# EasyEDA Pro project URADORRY-SUN.eprj, schematic Sub - ATmega32U4/Rev1.0
Create Date: 2024-05-28; Page Name: base; Project Name: URADORRY-SUN; Schematic Name: Sub - ATmega32U4/Rev1.0; Update Date: 2024-05-31; Add into BOM: yes; Company: 整数71の情報処理; Convert to PCB: yes; Drawed: 整数71
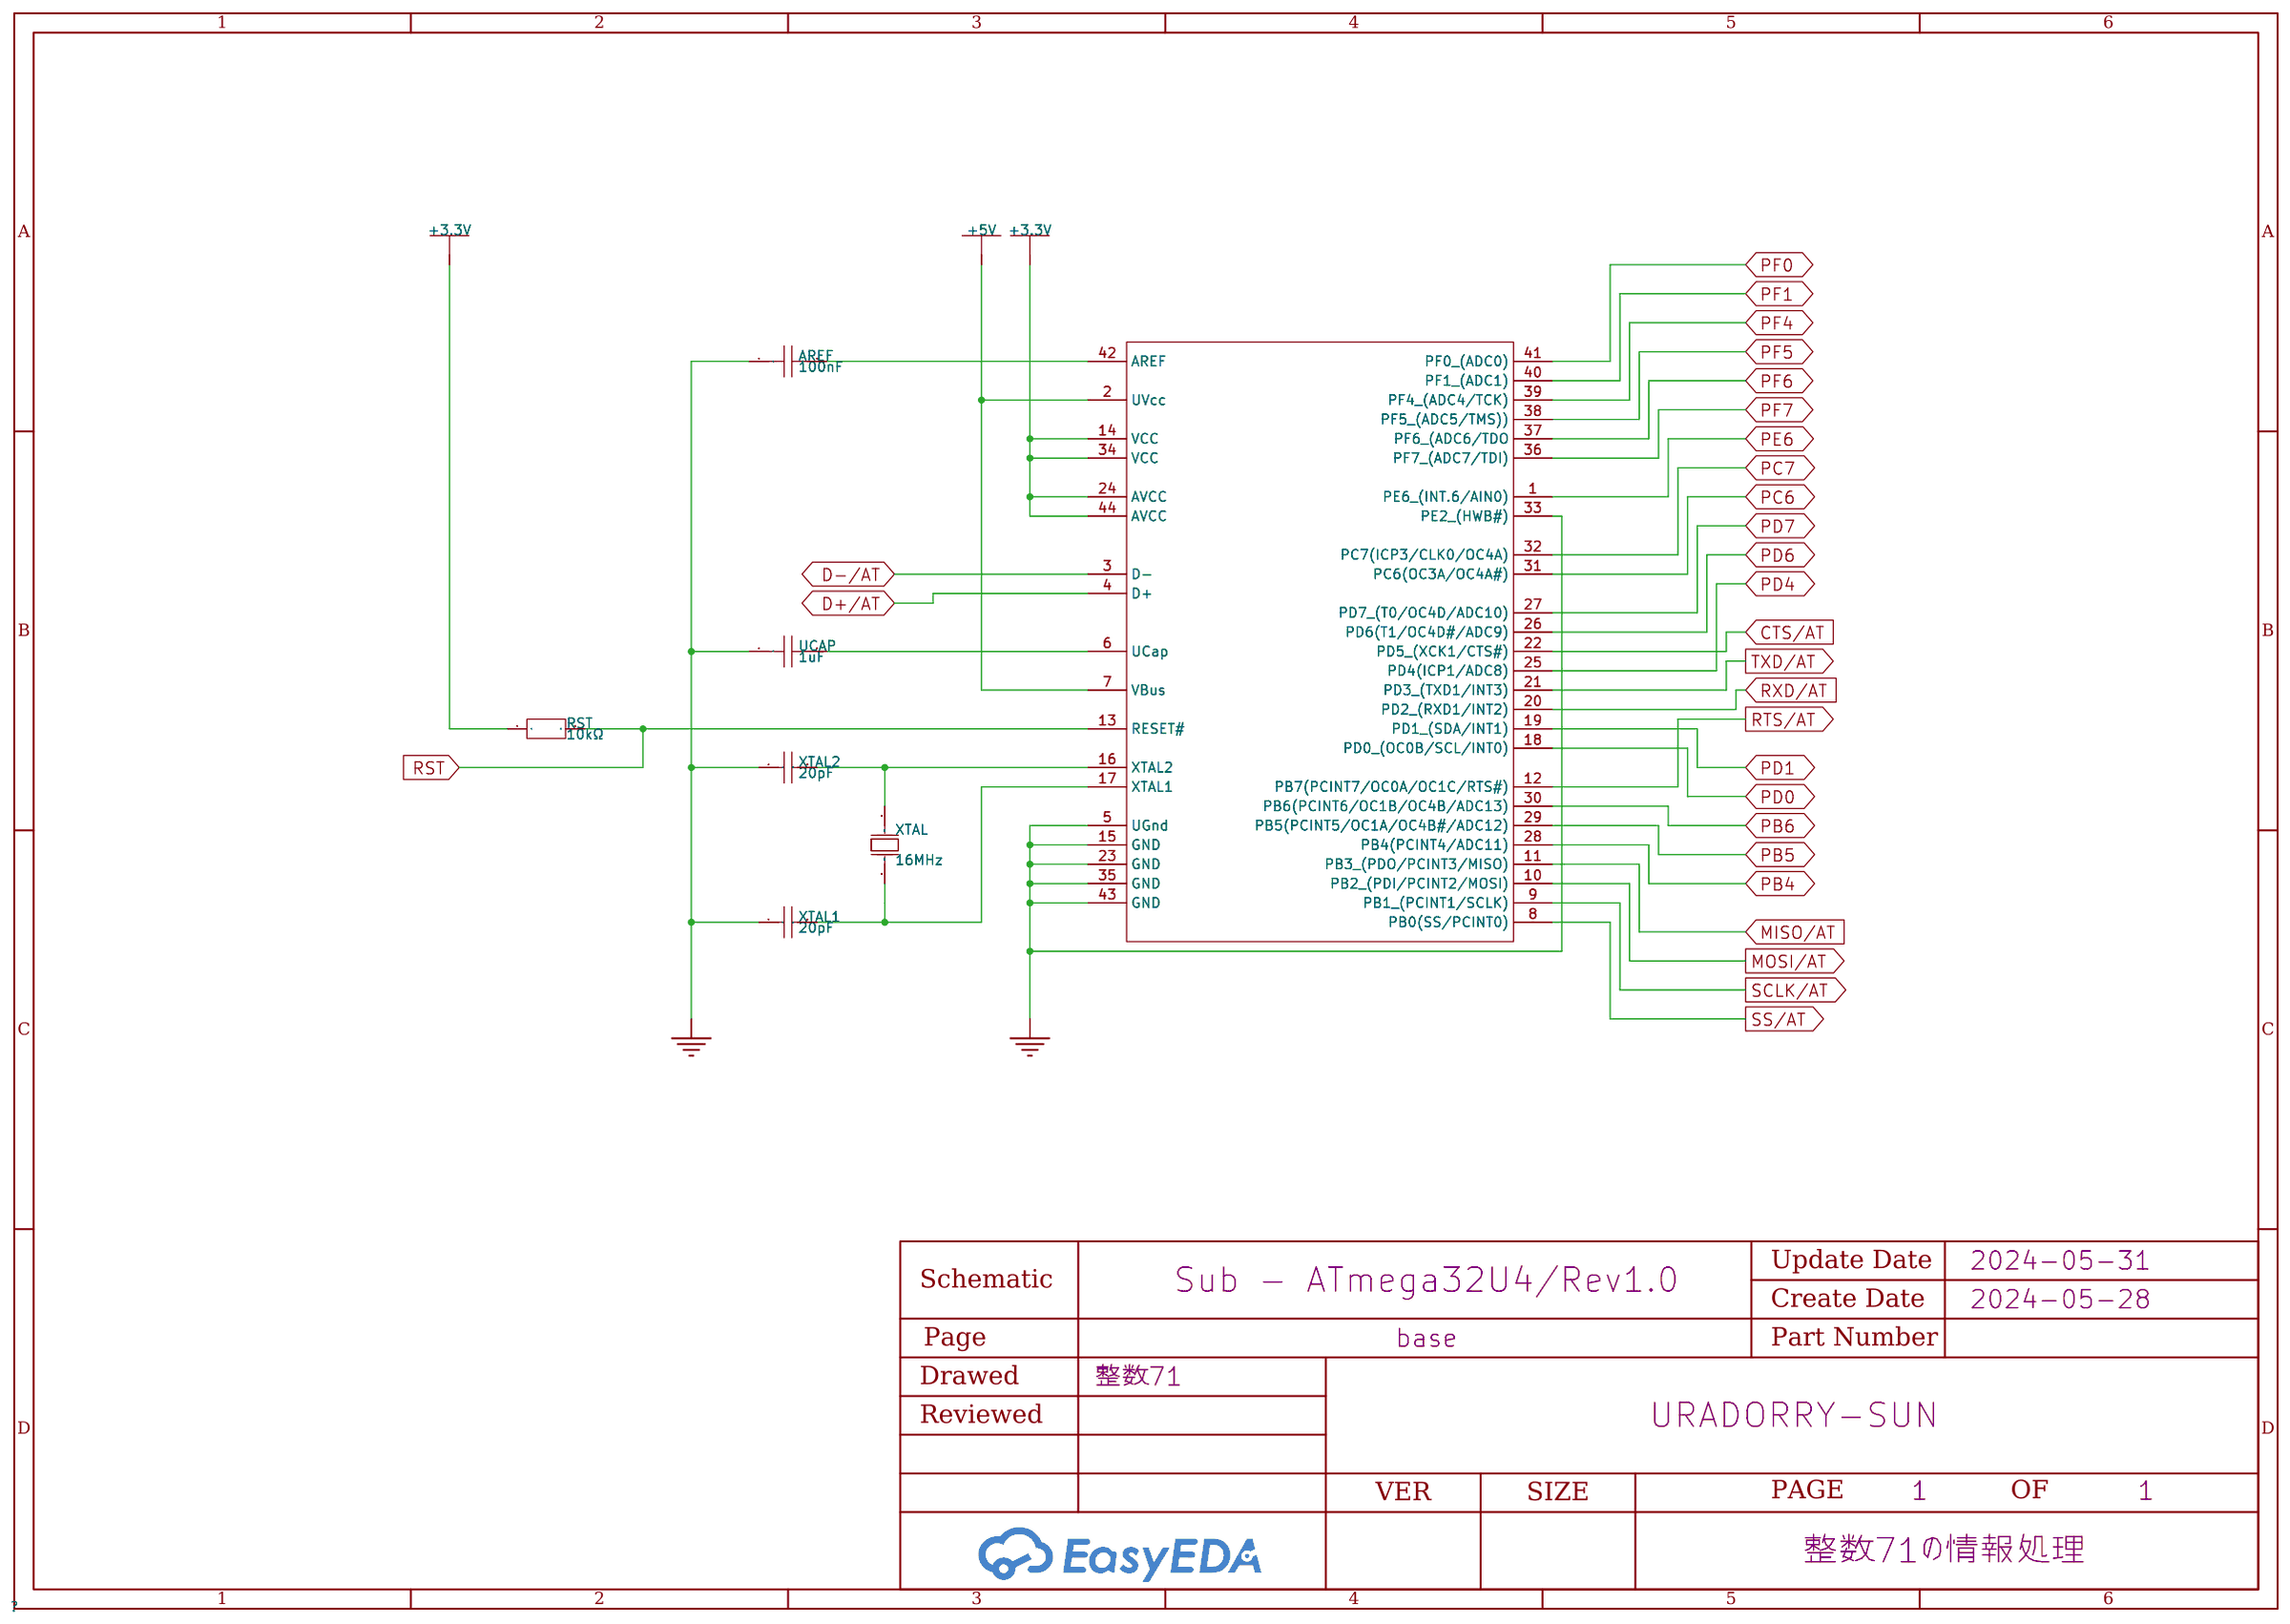
[diagram p0: schematic sheet]

## Parts
AREF  100nF  [CAP-TH_L5.8-W3.6-P5.0-D0.6]
ATmega32U4  ATMEGA32U4-AU  [QFP-44_L10.0-W10.0-P0.80-LS13.2-BL]
RST  10kΩ  [RES-TH_BD1.7-L3.5-P7.50-D0.5]
UCAP  1uF  [CAP-TH_L5.0-W3.2-P5.08-D0.6]
XTAL  16MHz  [HC-49US_L11.5-W4.5-P4.88]
XTAL1  20pF  [CAP-TH_L5.0-W3.2-P5.08-D0.6]
XTAL2  20pF  [CAP-TH_L5.0-W3.2-P5.08-D0.6]

## Library data of the parts
AREF = 100nF(Plugin 5.08mm): Capacitance: Tolerance:±10% Tolerance:±10% Voltage Rated: Temperature Coefficient:; Supplier: LCSC; Supplier Part: C5632426; Manufacturer: KNSCHA(科尼盛); Manufacturer Part: 178MU0002; JLCPCB Part Class: Extended Part; LCSC Part Name: 100nF ±10% 50V; Supplier Footprint: 插件,P=5.08mm; Datasheet: https://atta.szlcsc.com/upload/public/pdf/source/20230506/08E784E6BF236BA57EBA91152AC3AC6D.pdf; Tolerance: ±10%
ATmega32U4 = ATmega32U4(QFP-44): CPU Core:AVR Program Storage Size:32KB RAM Size:2.5KB GPIO Ports Number:26 Operating Voltage Range:2.7V~5.5V Operating Voltage Range:2.7V~5.5V CPU Maximum Speed:16MHz Program Memory Type:FLASH EEPROM:1KB Operating Temperature Range:-40℃~+85℃ Operating Tem; Supplier: LCSC; Manufacturer: MICROCHIP(美国微芯); Supplier Part: C44854; JLCPCB Part Class: Extended Part; Supplier Footprint: QFP-44(10x10); Datasheet: https://atta.szlcsc.com/upload/public/pdf/source/20150407/1457707275091.pdf; CPU Core: AVR; Program Storage Size: 32KB; RAM Size: 2.5KB; GPIO Ports Number: 26; Operating Voltage Range: 2.7V~5.5V; CPU Maximum Speed: 16MHz; Program Memory Type: FLASH; EEPROM: 1KB; Operating Temperature Range: -40℃~+85℃; ADC (Bit): 10bit; Universal Serial Bus: 有; Peripheral/Function: WDT；PWM; Watchdog: 有; Low-Voltage Detect: 有; Internal Oscillator: 有; Check: true
RST = 10kΩ(Plugin 3.5mm): Type:Metal Film Resistors Resistance: Tolerance:±1% Tolerance:±1% Overload Voltage (Max):150V Power(Watts):125mW Temperature Coefficient:±50ppm/℃ Temperature Coefficient:±50ppm/℃ Operating Temperature Range:-55℃~+125℃ Operating Temperature Range:-55℃~+125; LCSC Part Name: 10kΩ ±1% 125mW 金属膜电阻; Supplier Part: C433502; Manufacturer: Tyohm(幸亚电阻); Manufacturer Part: RN1/8W10KFT/BA1; Supplier Footprint: 插件,D1.7xL3.5mm; JLCPCB Part Class: Extended Part; Datasheet: https://atta.szlcsc.com/upload/public/pdf/source/20191008/C433681_B72693A7FD256E0D1DC5EFE3F095EED3.pdf; Supplier: LCSC; Type: Metal Film Resistors; Tolerance: ±1%; Overload Voltage (Max): 150V; Power(Watts): 125mW; Temperature Coefficient: ±50ppm/℃; Operating Temperature Range: -55℃~+125℃
UCAP = 1uF(Plugin 5.08mm): Capacitance:1uF Tolerance:±20% Tolerance:±20% Voltage Rated: Temperature Coefficient:; LCSC Part Name: 1uF ±20% 50V; Supplier Part: C2976636; Manufacturer: Dersonic(德尔创); Manufacturer Part: CD1H105MC9BEF4E100; Supplier Footprint: 插件,P=5.08mm; JLCPCB Part Class: Extended Part; Datasheet: https://atta.szlcsc.com/upload/public/pdf/source/20220304/12E3FCBE6570298965530FCA5B26E624.pdf; Supplier: LCSC; Tolerance: ±20%
XTAL = 16MHz - 20pF(HC-49S): Crystal Type:直插晶振 Frequency:16MHz Normal temperature Frequency Tolerance:±20ppm Normal temperature Frequency Tolerance:±20ppm External load capacitor:20pF Frequency Stability(Full temperature range):±20ppm Frequency Stability(Full temperature range):±20pp; LCSC Part Name: 16MHz ±20ppm 20pF; Supplier Part: C368764; Manufacturer: KYX(凯越翔); Manufacturer Part: KUS160001220; Supplier Footprint: HC-49S; JLCPCB Part Class: Extended Part; Datasheet: https://atta.szlcsc.com/upload/public/pdf/source/20190218/C368764_B585DF7714CC5499AB5DDC868219FA9C.pdf; Supplier: LCSC; Crystal Type: 直插晶振; Normal temperature Frequency Tolerance: ±20ppm; External load capacitor: 20pF; Frequency Stability(Full temperature range): ±20ppm; Equivalent Series Resistance (ESR): 60Ω
XTAL1 XTAL2 = 20pF(Plugin 5.08mm): Capacitance: Tolerance:±5% Tolerance:±5% Voltage Rated: Temperature Coefficient:NP0; Supplier: LCSC; Supplier Part: C2761744; Manufacturer: Dersonic(德尔创); Manufacturer Part: CD1H200JC9BECHD100; JLCPCB Part Class: Extended Part; LCSC Part Name: 20pF ±5% 50V; Supplier Footprint: 插件,P=5.08mm; Datasheet: https://atta.szlcsc.com/upload/public/pdf/source/20210512/C2761744_B1A0D4C027D843B54401A3CD3D312F15.pdf; Tolerance: ±5%; Temperature Coefficient: NP0

## Nets
+3.3V: ATmega32U4.14(VCC) ATmega32U4.24(AVCC) ATmega32U4.34(VCC) ATmega32U4.44(AVCC) RST.1
+5V: ATmega32U4.2(UVcc) ATmega32U4.7(VBus)
GND: AREF.1 ATmega32U4.5(UGnd) ATmega32U4.15(GND) ATmega32U4.23(GND) ATmega32U4.33(PE2 (HWB#)) ATmega32U4.35(GND) ATmega32U4.43(GND) UCAP.1 XTAL1.1 XTAL2.1
AREF: AREF.2 ATmega32U4.42(AREF)
CTS/AT: ATmega32U4.22(PD5 (XCK1/CTS#))
D+/AT: ATmega32U4.4(D+)
D-/AT: ATmega32U4.3(D-)
MISO/AT: ATmega32U4.11(PB3 (PDO/PCINT3/MISO))
MOSI/AT: ATmega32U4.10(PB2 (PDI/PCINT2/MOSI))
PB4: ATmega32U4.28(PB4(PCINT4/ADC11))
PB5: ATmega32U4.29(PB5(PCINT5/OC1A/OC4B#/ADC12))
PB6: ATmega32U4.30(PB6(PCINT6/OC1B/OC4B/ADC13))
PC6: ATmega32U4.31(PC6(OC3A/OC4A#))
PC7: ATmega32U4.32(PC7(ICP3/CLK0/OC4A))
PD0: ATmega32U4.18(PD0 (OC0B/SCL/INT0))
PD1: ATmega32U4.19(PD1 (SDA/INT1))
PD4: ATmega32U4.25(PD4(ICP1/ADC8))
PD6: ATmega32U4.26(PD6(T1/OC4D#/ADC9))
PD7: ATmega32U4.27(PD7 (T0/OC4D/ADC10))
PE6: ATmega32U4.1(PE6 (INT.6/AIN0))
PF0: ATmega32U4.41(PF0 (ADC0))
PF1: ATmega32U4.40(PF1 (ADC1))
PF4: ATmega32U4.39(PF4 (ADC4/TCK))
PF5: ATmega32U4.38(PF5 (ADC5/TMS)))
PF6: ATmega32U4.37(PF6 (ADC6/TDO)
PF7: ATmega32U4.36(PF7 (ADC7/TDI))
RST: ATmega32U4.13(RESET#) RST.2
RTS/AT: ATmega32U4.12(PB7(PCINT7/OC0A/OC1C/RTS#))
RXD/AT: ATmega32U4.20(PD2 (RXD1/INT2))
SCLK/AT: ATmega32U4.9(PB1 (PCINT1/SCLK))
SS/AT: ATmega32U4.8(PB0(SS/PCINT0))
TXD/AT: ATmega32U4.21(PD3 (TXD1/INT3))
UCAP: ATmega32U4.6(UCap) UCAP.2
XTAL1: ATmega32U4.17(XTAL1) XTAL.2(OSC2) XTAL1.2
XTAL2: ATmega32U4.16(XTAL2) XTAL.1(OSC1) XTAL2.2
